# EasyEDA Pro project Athena.epro, board PCB (continued)
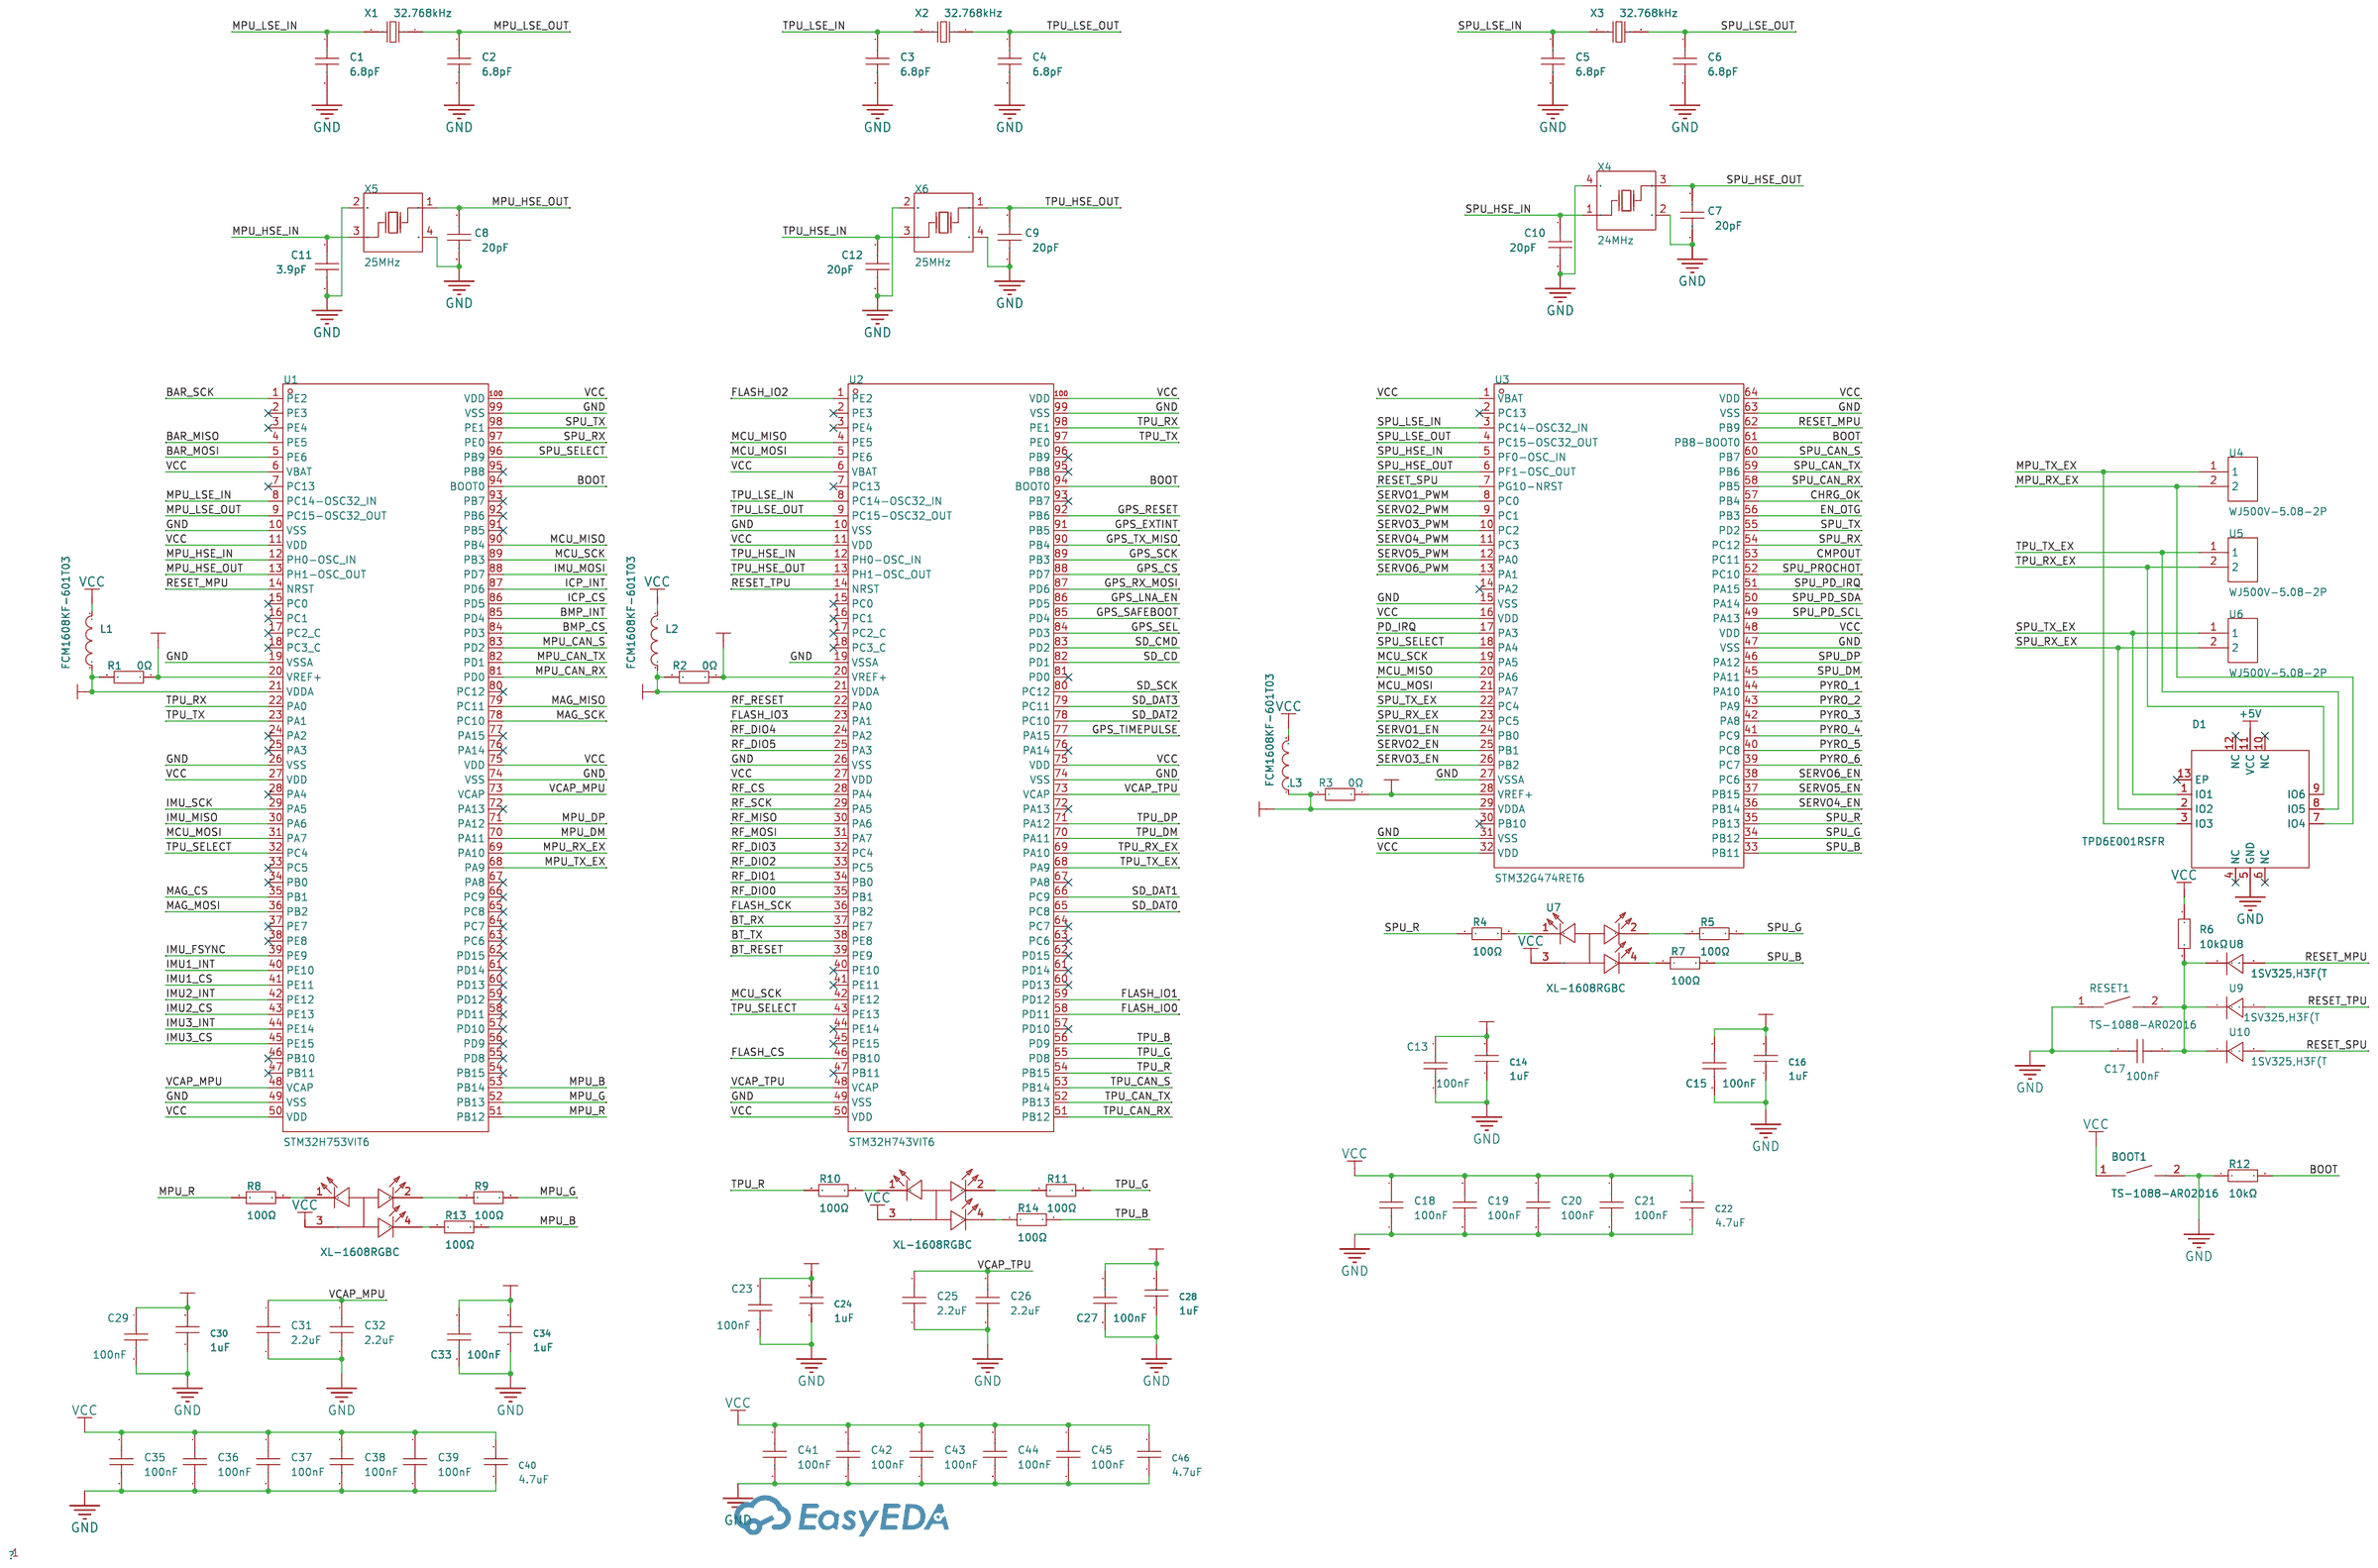
[diagram p0: Processors]
## Routing (per net, layer and track width the routed paths; a pad name or vN(x,y) marks a point on that pad's centre or on a via; arc(x,y) is an arc through that point) (continued)
RF_MOSI: length 46.1
  Top Layer w0.2: 18.86,90.71 17.8,91.77 17.8,124.4 23.9,130.5 26.95,130.5 U24.14
RF_RESET: length 46.2
  Top Layer w0.2: v1(12.8,128.65) 11.15,128.65 11.12,128.68 ; U2.22 23.09,90.65 22.35,90.65 21.58,91.42 21.58,121.07 v1(20.25,122.4)
  Bottom Layer w0.2: v1(20.25,122.4) 19.05,122.4 v1(12.8,128.65)
RF_SCK: length 42.3
  Top Layer w0.2: U24.12 21.48,126.68 18.8,124 18.8,92.19 19.57,91.42
SD_CD: length 33.2
  Top Layer w0.2: v1(23.78,76.58) 23.8,76.58 24.94,75.44
  SIGNAL w0.2: v1(16.87,101.9) 16.87,82.93 23.22,76.58 v1(23.78,76.58)
  Bottom Layer w0.2: R103.1 17.97,101.9 v1(16.87,101.9) 16.83,101.94 CARD1.CD
SD_CMD: length 39
  Top Layer w0.2: v1(23.4,77.2) 23.9,77.2 25.19,75.9 25.19,75.89 25.29,75.79
  SIGNAL w0.2: v1(16.33,108.54) 17.4,107.46 17.4,83.2 v1(23.4,77.2)
  Bottom Layer w0.2: R100.1 16.46,108.4 v1(16.33,108.54) CARD1.3
SD_DAT0: length 39.1
  Top Layer w0.2: v1(15.3,75) 15.3,75.06 17.09,76.85
  Bottom Layer w0.2: R101.1 16.91,104.14 CARD1.7 15.03,104.1 13,104.1 11.6,102.7 11.6,76.7 13.3,75 v1(15.3,75)
SD_DAT1: length 36.9
  Top Layer w0.2: v1(16.4,75.5) 16.49,75.59 16.49,75.6 17.39,76.5 17.45,76.5
  Bottom Layer w0.2: R102.1 15.11,103 CARD1.8 12.94,103.04 12.15,102.25 12.15,76.85 13.5,75.5 v1(16.4,75.5)
SD_DAT2: length 42.8
  Top Layer w0.2: 23.53,74.02 22.74,74.81 v1(22.61,74.81)
  SIGNAL w0.2: v1(22.61,74.81) 15.3,82.12 15.3,109.69 v1(16.32,110.71)
  Bottom Layer w0.2: R98.1 16.41,110.8 v1(16.32,110.71) 16.29,110.74 CARD1.1
SD_DAT3: length 41.1
  Top Layer w0.2: v1(23.1,75.1) 23.16,75.1 23.88,74.38
  SIGNAL w0.2: v1(16.32,109.64) 15.8,109.12 15.8,82.4 v1(23.1,75.1)
  Bottom Layer w0.2: R99.1 17.23,109.64 v1(16.32,109.64) CARD1.2
SD_SCK: length 36.1
  Top Layer w0.2: v1(23.4,75.6) 23.4,75.56 24.23,74.73
  SIGNAL w0.2: v1(16.32,106.34) 16.32,82.68 v1(23.4,75.6)
  Bottom Layer w0.2: CARD1.5 v1(16.32,106.34)
SERVO1_EN: length 108.4
  Top Layer w0.2: Q12.1 25.85,12.05 v1(25.9,12.1) ; v1(54.58,68.18) 62.6,76.2 62.6,77.5 61.52,78.58 U3.24
  SIGNAL w0.2: v1(54.58,68.18) 68.8,53.96 68.8,32.3 64.4,27.9 41.5,27.9 25.9,12.3 v1(25.9,12.1)
SERVO1_PWM: length 112.3
  Top Layer w0.2: v1(52,77.6) 53.37,78.97 U3.8
  SIGNAL w0.2: S1.3 25.3,12.29 41.31,28.3 64.2,28.3 68.4,32.5 68.4,53.7 50.1,72 50.1,75.7 v1(52,77.6)
SERVO2_EN: length 107.4
  Top Layer w0.2: U3.25 63,77.85 63,75.96 v1(55.55,68.51) ; Q13.1 29.2,11.15 v1(29.2,12.1)
  SIGNAL w0.2: v1(29.2,12.1) 29.2,14.4 41.9,27.1 64.8,27.1 69.6,31.9 69.6,54.46 v1(55.55,68.51)
SERVO2_PWM: length 111
  Top Layer w0.2: U3.9 53.72,78.62 v1(52.7,77.6)
  SIGNAL w0.2: v1(52.7,77.6) 50.9,75.8 50.9,72.5 69.2,54.2 69.2,32.1 64.6,27.5 41.7,27.5 28.15,13.95 S2.3
SERVO3_EN: length 106.4
  Top Layer w0.2: v1(56.52,68.82) 63.4,75.7 63.4,78.16 62.23,79.33 ; Q14.1 v1(32.45,12.1)
  SIGNAL w0.2: v1(56.52,68.82) 70.4,54.94 70.4,31.5 65.2,26.3 42.3,26.3 32.45,16.45 v1(32.45,12.1)
SERVO3_PWM: length 109.5
  Top Layer w0.2: v1(52.7,76.9) 54.07,78.27 U3.10
  SIGNAL w0.2: v1(52.7,76.9) 51.8,76 51.8,72.9 70,54.7 70,31.7 65,26.7 42.1,26.7 31.01,15.61 S3.3
SERVO4_EN: length 105.1
  Top Layer w0.2: Q15.1 v1(49.15,13.95) ; v1(57.49,69.15) 66.1,77.76 66.1,86 65.47,86.63 64.59,86.63 U3.36
  SIGNAL w0.2: v1(49.15,13.95) 49.15,22.95 51.7,25.5 65.57,25.5 71.2,31.13 71.2,55.44 v1(57.49,69.15)
SERVO4_PWM: length 96.7
  Top Layer w0.2: v1(53.4,76.9) 54.41,77.91 U3.11
  SIGNAL w0.2: S4.3 48.66,23.06 51.5,25.9 65.4,25.9 70.8,31.3 70.8,55.2 52.6,73.4 52.6,76.1 v1(53.4,76.9)
SERVO5_EN: length 103.1
  Top Layer w0.2: v1(58.46,69.48) 66.5,77.52 66.5,86.2 65.6,87.1 64.35,87.1 U3.37 ; Q16.1 v1(52.45,11.9)
  SIGNAL w0.2: v1(52.45,11.9) 52.45,22.05 55.1,24.7 66,24.7 72,30.7 72,55.94 v1(58.46,69.48)
SERVO5_PWM: length 93.6
  Top Layer w0.2: U3.12 54.76,77.56 v1(53.4,76.2)
  SIGNAL w0.2: v1(53.4,76.2) 53.4,73.9 71.6,55.7 71.6,30.9 65.8,25.1 54.9,25.1 51.52,21.72 S5.3
SERVO6_EN: length 102.2
  Top Layer w0.2: v1(59.43,69.81) 66.9,77.28 66.9,86.4 65.8,87.5 64.04,87.5 U3.38 ; Q17.1 v1(55.75,12)
  SIGNAL w0.2: v1(59.43,69.81) 72.8,56.44 72.8,30.3 66.4,23.9 56.6,23.9 55.75,23.05 v1(55.75,12)
SERVO6_PWM: length 91.6
  Top Layer w0.2: 55.16,77.2 55.16,77.16 v1(54.2,76.2)
  SIGNAL w0.2: v1(54.2,76.2) 54.2,74.4 72.4,56.2 72.4,30.5 66.2,24.3 56.4,24.3 54.87,22.77 54.87,7.24 54.47,6.84 S6.3
SPU_B: length 16.7
  Top Layer w0.2: v1(75.5,92.9) 75.5,92.9 R7.2 ; U3.33 64.4,84.28 65.32,85.2 v1(65.55,85.2)
  SIGNAL w0.2: v1(65.55,85.2) 65.59,85.24 67.84,85.24 v1(75.5,92.9)
SPU_CAN_RX: length 40.6
  Top Layer w0.2: 53.04,86.4 51.93,87.5 50.55,87.5 46.8,83.75 46.8,73.85 50.95,69.7 50.95,61.5 48.06,58.61 U25.4
SPU_CAN_S: length 43.2
  Top Layer w0.2: U25.8 52.42,49.32 52.42,69.53 47.7,74.25 47.7,83.45 50.9,86.65 51.37,86.65 U3.60
SPU_CAN_TX: length 38.5
  Top Layer w0.2: U25.1 51.87,69.43 47.25,74.05 47.25,83.6 50.75,87.1 51.68,87.1 52.68,86.09 U3.59
SPU_DM: length 115.4
  Top Layer w0.2: U23.11 52.68,19.4 52.91,19.62 53.25,19.62 53.6,19.97 53.6,22.25 54.26,22.9 54.26,24.82 51.29,27.78 51.29,27.98 R94.2 51.29,29.1 51.29,30.9 51.39,31 v1(51.39,31.4) ; v1(58.6,87) 60.11,88.51 U3.45
  SIGNAL w0.2: v1(51.39,31.4) 51.39,31.8 51.29,31.9 51.29,32.25 49.39,34.15 32.75,34.15 24.15,42.75 24.15,64.05 35.29,75.2 46.65,75.2 58.46,87 v1(58.6,87)
SPU_DP: length 115.3
  Top Layer w0.2: U3.46 59.75,88.85 v1(58.6,87.7) ; v1(50.84,31.4) 50.84,31 50.94,30.9 50.94,29.18 R93.2 50.94,28.06 50.94,27.63 53.9,24.67 53.9,23.05 53.25,22.39 53.25,20.12 53.11,19.98 52.91,19.98 52.68,20.2 U23.12
  SIGNAL w0.2: v1(58.6,87.7) 58.6,87.64 58.37,87.41 58.01,87.41 57.11,86.51 57.11,86.15 46.51,75.55 35.15,75.55 23.8,64.2 23.8,42.6 32.6,33.8 49.24,33.8 50.94,32.1 50.94,31.9 50.84,31.8 v1(50.84,31.4)
SPU_G: length 15.7
  Top Layer w0.2: v1(65.17,85.69) 65.06,85.69 U3.34 ; R5.2 74.25,94.87 v1(74.25,92.89)
  SIGNAL w0.2: v1(65.17,85.69) 67.05,85.69 v1(74.25,92.89)
SPU_HSE_IN: length 6.1
  Top Layer w0.2: U3.5 50.7,78.4 v1(50.7,77.36)
  Bottom Layer w0.2: X4.1 51.04,77.02 v1(50.7,77.36) 50.12,77.36 C10.1
SPU_HSE_OUT: length 9.7
  Top Layer w0.2: v1(51.19,77.71) 51.19,78.15 52.58,79.54 52.58,79.58 U3.6
  Bottom Layer w0.2: 52.74,72.1 52.43,72.1 X4.3 51.39,74.69 52.21,75.51 52.21,76.69 v1(51.19,77.71)
SPU_LSE_IN: length 6.9
  Top Layer w0.2: v1(48.35,79.31) 50.19,79.31 U3.3
  Bottom Layer w0.2: v1(48.35,79.31) 47.5,80.15 X3.2 46.23,78.97 C5.1
SPU_LSE_OUT: length 7.2
  Top Layer w0.2: v1(48.35,78.71) 50.3,78.71 U3.4
  Bottom Layer w0.2: 49.12,78.39 47.8,77.06 ; 49.12,78.39 48.67,78.39 v1(48.35,78.71) ; 49.12,78.39 X3.1
SPU_PD_IRQ: length 59.8
  Top Layer w0.2: U3.51 57.25,87.13 57.25,73.4 52.8,68.95 52.8,50.52 62.75,40.57 62.75,39.2 64.2,37.75 v1(64.2,37.2)
  Bottom Layer w0.2: U20.10 64.14,37.26 v1(64.2,37.2)
SPU_PD_SCL: length 59.9
  Top Layer w0.2: v1(63.6,39.66) 63.6,40.95 53.7,50.85 53.7,68.55 58.04,72.89 58.04,87.75 56.22,89.58
  Bottom Layer w0.2: v1(63.6,39.66) 63.88,39.66 64.45,39.09 64.45,38.1 64.01,37.66 U20.9
SPU_PD_SDA: length 58.9
  Top Layer w0.2: U3.50 57.65,87.44 57.65,73.15 53.25,68.75 53.25,50.67 63.15,40.77 63.15,39.47 63.51,39.11 v1(63.55,39.11)
  Bottom Layer w0.2: v1(63.55,39.11) 63.84,39.11 64.07,38.88 64.07,38.27 63.86,38.06 U20.8
SPU_PROCHOT: length 74.6
  Top Layer w0.2: U3.52 53.27,90.4 50.9,90.4 44.95,84.45 44.95,73.2 49.35,68.8 49.35,62.3 45.65,58.6 45.65,49.73 40.82,44.9 38.47,44.9 33.92,40.35 32.75,40.35 31.75,39.35 31.75,38.71 32.06,38.4 33,38.4 v1(33.05,38.45)
  Bottom Layer w0.2: v1(33.05,38.45) 33.32,38.45 33.56,38.21 33.86,38.5 U19.11
SPU_R: length 14.6
  Top Layer w0.2: R4.1 72.96,92.91 v1(72.95,92.9) ; v1(64.85,86.18) 63.65,84.98 U3.35
  SIGNAL w0.2: v1(64.85,86.18) 66.23,86.18 v1(72.95,92.9)
SPU_RX: length 10.4
  Top Layer w0.2: U1.97 49.45,94.45 v1(49.45,94.45) ; v1(53,89.25) 53.01,89.25 U3.54
  Bottom Layer w0.2: v1(49.45,94.45) 53,90.9 v1(53,89.25)
SPU_RX_EX: length 65.4
  Top Layer w0.2: v1(13.2,67.7) 13.22,67.72 v1(15.37,67.72) ; v1(60.05,79.4) 60.05,79.38 U3.23
  SIGNAL w0.2: v1(60.05,79.4) 57.82,81.62 53.78,81.62 46.43,74.28 38.07,74.28 31.7,67.9 v1(31.7,67.85)
  Bottom Layer w0.2: v1(31.7,67.85) 31.4,67.55 31.39,67.55 31.39,67.55 15.54,67.55 v1(15.37,67.72) ; U6.2 10.34,64.84 v1(13.2,67.7) 13.8,68.3 D1.2
SPU_SELECT: length 23.6
  Top Layer w0.2: v1(58.5,77.9) 58.5,77.4 U3.18 ; U1.96 48.69,94.5 v1(48.7,94.5)
  Bottom Layer w0.2: v1(48.7,94.5) 52.55,90.65 52.55,88.44 55.8,85.18 55.8,80.7 58.5,78 v1(58.5,77.9)
SPU_TX: length 11.1
  Top Layer w0.2: U3.55 53.04,88.52 v1(53.04,88.59) ; v1(49.55,95.05) 49.55,95.05 U1.98
  Bottom Layer w0.2: v1(53.04,88.59) 53.45,89 53.45,91.15 v1(49.55,95.05)
SPU_TX_EX: length 67.3
  Top Layer w0.2: v1(59.48,79.33) 59.48,79.25 60.81,77.91
  SIGNAL w0.2: v1(59.48,79.33) 59.48,79.43 57.66,81.25 53.95,81.25 46.6,73.9 38.25,73.9 32.27,67.92 v1(32.27,67.83)
  Bottom Layer w0.2: U6.1 6.31,59.76 14.6,68.05 ; v1(32.27,67.83) 32.27,67.78 31.69,67.2 15.25,67.2 14.6,67.85 14.6,68.05 ; 14.6,68.05 D1.1
TPU_B: length 24.9
  Top Layer w0.2: v1(15.4,81.13) 14.98,81.13 U2.56 ; v1(4.35,93.55) 4.35,95.44 R14.2
  GND w0.2: v1(15.4,81.13) 8.57,81.13 7.1,82.6 7.1,90.75 4.35,93.5 v1(4.35,93.55)
TPU_CAN_RX: length 44.2
  Top Layer w0.2: U26.4 28.25,56.35 24.25,60.35 11.65,60.35 8.9,63.1 8.9,78.58 12.12,81.8
TPU_CAN_S: length 54
  Top Layer w0.2: U2.53 9.9,78.17 9.9,63.55 12.1,61.35 28.35,61.35 33.7,56 33.7,49.75 32.73,48.78 U26.8
TPU_CAN_TX: length 47.3
  Top Layer w0.2: U26.1 32.06,56.84 28.05,60.85 11.85,60.85 9.4,63.3 9.4,78.38 U2.52
TPU_DM: length 70.9
  Top Layer w0.2: v1(17.62,73.87) 17.65,73.87 18.86,75.08 ; v1(33.2,32.65) 33.6,32.65 33.7,32.55 38.99,32.55 42.4,29.14 42.4,28.79 R87.2 42.4,27.8 42.4,27.6 43.2,26.8 48.03,26.8 48.38,26.45 48.38,26.11 48.6,25.88 U23.19
  SIGNAL w0.2: v1(17.62,73.87) 17.62,73.78 22.6,68.8 22.6,42.25 32.3,32.55 33.1,32.55 v1(33.2,32.65)
TPU_DP: length 70.8
  Top Layer w0.2: 19.21,74.73 17.63,73.14 v1(17.63,73.13) ; v1(33.2,32.1) 33.6,32.1 33.7,32.2 38.84,32.2 42.05,29 42.05,28.79 R86.2 42.05,27.8 42.05,27.45 43.05,26.45 47.88,26.45 48.02,26.31 48.02,26.11 47.8,25.88 U23.20
  SIGNAL w0.2: v1(17.63,73.13) 17.77,73.13 18.38,72.52 18.38,72.17 19.28,71.27 19.63,71.27 22.25,68.65 22.25,42.11 32.15,32.2 33.1,32.2 v1(33.2,32.1)
TPU_G: length 23.7
  Top Layer w0.2: v1(15.12,81.65) 14.79,81.65 U2.55 ; R11.2 v1(5.77,93.55)
  GND w0.2: v1(5.77,93.55) 5.92,93.55 7.5,91.97 7.5,82.75 8.65,81.6 15.07,81.6 v1(15.12,81.65)
TPU_HSE_IN: length 5.7
  Top Layer w0.2: 27.39,87.89 27.39,87.89 v1(28.4,88.9)
  Bottom Layer w0.2: X6.3 29.67,90.17 v1(28.4,88.9)
  Bottom Layer w0.4: 31.01,90 30.1,90.91 X6.3
TPU_HSE_OUT: length 8.8
  Top Layer w0.2: U2.13 v1(27.8,89)
  Bottom Layer w0.2: v1(27.8,89) 28.4,89.6 28.4,91.2 29.42,92.22 29.42,93.57
  Bottom Layer w0.4: 27.08,94.06 27.13,94.01 27.9,94.01 27.96,94.06 28.92,94.06 X6.1
TPU_LSE_IN: length 7.7
  Top Layer w0.2: v1(29.85,87.5) 29.84,87.5 U2.8
  Bottom Layer w0.2: 33.86,86.79 31.94,86.79 31.22,87.5 v1(29.85,87.5)
  Bottom Layer w0.4: C3.1 35.24,88.16 X2.2
TPU_LSE_OUT: length 6.3
  Top Layer w0.2: U2.9 29.18,87.55 v1(29.2,87.55)
  Bottom Layer w0.2: X2.1 30.26,88.61 v1(29.2,87.55)
  Bottom Layer w0.4: X2.1 32.15,88.62 C4.1
TPU_R: length 23.4
  Top Layer w0.2: v1(7.15,93.55) 7.17,93.57 R10.1 ; v1(14.85,82.9) 14.85,82.41 U2.54
  GND w0.2: v1(14.85,82.9) 14.85,82.85 14.1,82.1 8.75,82.1 7.85,83 7.85,92.9 7.2,93.55 v1(7.15,93.55)
TPU_RX: length 32.2
  Top Layer w0.2: U1.22 41.03,105.45 v1(41.03,105.44) ; U2.98 31.16,80.52 32.48,80.52 v1(32.5,80.54)
  SIGNAL w0.2: v1(41.03,105.44) 40.98,105.39 40.69,105.39 32.3,97 32.3,80.74 v1(32.5,80.54)
TPU_RX_EX: length 22.9
  Top Layer w0.2: U2.69 17.08,74.04 v1(17.01,74.04)
  Bottom Layer w0.2: 14.6,73.08 7.95,79.73 7.95,84.89 U5.2 ; 14.6,73.08 14.73,72.95 15.1,72.95 16.19,74.04 v1(17.01,74.04) ; 14.6,73.08 D1.9
TPU_SELECT: length 37.7
  Top Layer w0.2: U1.32 37.35,104.42 37.35,99 34.7,96.35 v1(34.25,96.35) ; v1(13,88.05) 14.58,86.47 U2.43
  Bottom Layer w0.2: v1(13,88.05) 21.25,96.3 34.2,96.3 v1(34.25,96.35)
TPU_TX: length 32.7
  Top Layer w0.2: U1.23 40.76,105.89 v1(40.68,105.89) ; v1(32.02,80.06) 30.9,80.06 U2.97
  SIGNAL w0.2: v1(40.68,105.89) 40.68,105.81 32,97.12 32,80.09 v1(32.02,80.06)
TPU_TX_EX: length 19.1
  Top Layer w0.2: v1(16.5,73.59) 16.5,74.16 U2.68
  Bottom Layer w0.2: U5.1 5.8,81.08 13.8,73.08 D1.8 13.8,72.5 14.15,72.15 15.06,72.15 v1(16.5,73.59)
USB_CC1: length 12.4
  Top Layer w0.2: v1(37.6,12.9) 37.6,8.78 38.75,7.63 USB1.4
  Bottom Layer w0.2: D2.7 39.78,12.72 39.78,13.22 39.62,13.38 37.95,13.38 37.6,13.03 v1(37.6,12.9) 37.52,12.82 37.52,12.75 37.59,12.69 37.52,12.62 37.52,12.04 37.96,11.6 D2.4
USB_CC2: length 8.7
  Top Layer w0.2: USB1.10 41.75,9.65 v1(38.8,12.6)
  Bottom Layer w0.2: D2.5 38.7,12.5 v1(38.8,12.6) 39.3,12.6 D2.6
USB_DN: length 14.4
  Top Layer w0.2: R96.1 45.52,12.94 45.52,11.52 v1(42.9,8.9) ; 39.3,7 39.25,6.95 USB1.5 ; 39.3,7 v1(39.3,7.91) ; 39.3,7 39.32,7.02 39.32,7.04 39.48,7.2 40.02,7.2 40.25,6.97 USB1.7
  Bottom Layer w0.2: D2.20 39.4,8.01 v1(39.3,7.91) 41.91,7.91 v1(42.9,8.9)
USB_DP: length 13.3
  Top Layer w0.2: v1(39.98,8.5) 40.75,7.74 USB1.8 40.75,5.75 40.55,5.55 39.98,5.55 39.75,5.78 USB1.6 ; R95.1 44.35,11.48 v1(42.49,9.61)
  Bottom Layer w0.2: v1(42.49,9.61) 41.38,8.5 v1(39.98,8.5) 39.8,8.69 D2.19
USB_SBU1: length 5.7
  Top Layer w0.2: v1(38.7,9.6) 39.21,9.09 40.23,9.09 41.25,8.06 USB1.9
  Bottom Layer w0.2: v1(38.7,9.6) D2.1
USB_SBU2: length 5.7
  Top Layer w0.2: USB1.3 38.25,6.38 38.25,7.15 37.5,7.9 v1(37.4,7.9)
  Bottom Layer w0.2: v1(37.4,7.9) 37.44,7.94 37.44,9.63 37.73,9.92 37.73,10.41 38.14,10.82 38.68,10.82 D2.2
USB_XTAL1: length 9.5
  Top Layer w0.2: U23.30 v1(38.9,19.4)
  Bottom Layer w0.2: v1(38.9,19.4) 37.69,18.19 X7.1 38.56,15.97 C114.1
USB_XTAL2: length 9.8
  Top Layer w0.2: v1(38.9,20.2) U23.29
  Bottom Layer w0.2: C116.1 40.23,24.04 X7.3 38.9,21.8 v1(38.9,20.2)
VCAP_MPU: length 16.2
  Top Layer w0.2: v1(38.8,89.78) 37.94,88.92 U1.73 ; v1(31.55,98.93) 30.89,99.6 U1.48
  GND w0.2: v1(38.8,89.78) 31.55,97.03 v1(31.55,98.93)
  Bottom Layer w0.2: C31.1 38.8,89.91 v1(38.8,89.78) ; v1(31.55,98.93) 31.58,98.93 C32.1
VCAP_TPU: length 16.9
  Top Layer w0.2: v1(13.62,83.9) 12.85,84.67 12.85,84.7 ; 19.92,74.02 20.7,74.8 v1(20.72,74.8)
  GND w0.2: v1(13.62,83.9) 13.87,83.65 14.74,83.65 20.72,77.66 v1(20.72,74.8)
  Bottom Layer w0.2: v1(13.62,83.9) 13.92,83.6 C25.1 ; 20.56,75.92 20.72,75.76 v1(20.72,74.8)
VREF+_MPU: length 10.6
  Top Layer w0.2: 42.6,105.61 41.7,104.71 v1(41.7,99.3)
  Bottom Layer w0.2: R1.2 41.85,100.58 C33.1 40.62,99.31 C34.2 40.67,99.3 v1(41.7,99.3)
VREF+_SPU: length 6
  Top Layer w0.2: v1(61.2,80.9) 62.07,80.9 U3.28
  Bottom Layer w0.2: 59.75,80.91 R3.2 60.31,80.9 v1(61.2,80.9) ; 59.75,80.91 C16.2 ; 59.75,80.91 59.14,80.91 C15.1
VREF+_TPU: length 6.5
  Top Layer w0.2: v1(23,88.49) 23,89.15 U2.20
  Bottom Layer w0.2: 23.63,89.12 v1(23,88.49) ; 23.63,89.12 23.63,87.86 24.91,87.86 ; 23.63,89.12 23.68,89.17 R2.2
VSYS: length 13.7
  Top Layer w0.2: v1(19.2,29.6) 19.2,31.25 U14.2
  Bottom Layer w0.2: R15.2 v1(19.2,29.6) ; 31.2,42.87 30.17,42.87 29.64,43.4 v1(25.9,43.4)
  Bottom Layer w0.4: U17.5 13.64,61.26 14.59,60.31 U17.3 15.25,60.26 C59.1
  vias: v1(9.2,58.05) v1(9.2,57.05) v1(9.8,49.4) v1(10.2,58.05) v1(10.2,57.05) v1(10.55,49.4) v1(11.2,58.05) v1(11.2,57.05) v1(11.3,49.4) v1(11.8,32.1) v1(11.8,31.4) v1(11.8,30.7) v1(12.05,49.4) v1(12.2,58.05) v1(12.2,57.05) v1(12.55,32.1) v1(12.55,31.4) v1(12.55,30.7) v1(12.8,49.4) v1(13.2,58.05) v1(13.2,57.05) v1(13.3,32.1) v1(13.3,31.4) v1(13.3,30.7) v1(13.55,49.4) v1(14.05,32.1) v1(14.05,31.4) v1(14.05,30.7) v1(14.2,57.05) v1(14.3,49.4) v1(15.05,49.4) v1(15.8,49.4) v1(16.55,49.4) v1(17.3,49.4) v1(18.05,49.4) v1(18.8,49.4) v1(19.55,49.4) v1(20.3,49.4) v1(21.05,49.4)
$1N13958: length 1.6
  Top Layer w0.2: U11.1 41.83,117.07 R8.2
$1N14012: length 1.5
  Top Layer w0.2: R9.1 40.56,117.14 U11.2
$1N14042: length 2.3
  Top Layer w0.2: R13.1 39.29,118.2 39.65,118.56 U11.4
$1N15981: length 1.4
  Top Layer w0.2: R10.2 7.17,96.58 U12.1
$1N15984: length 1.3
  Top Layer w0.2: R11.1 5.77,96.78 U12.2
$1N15987: length 2.3
  Top Layer w0.2: R14.1 4.37,97.66 4.78,98.07 U12.4
$1N16115: length 3.6
  Top Layer w0.2: U7.1 72.55,97.55 72.2,97.2 72.2,96.08 72.53,95.75 R4.2
$1N16118: length 2.4
  Top Layer w0.2: R5.1 74.21,95.77 74.21,97.41 74.35,97.55 U7.2
$1N16121: length 1.4
  Top Layer w0.2: U7.4 75.5,96.2 R7.1
$1N31524: length 9.6
  Bottom Layer w0.4: U8.1 60.2,66.9 R6.1 60.2,63.02 RESET1.2 58.69,61.51 C17.1 ; U8.1 U9.1 ; U8.1 U10.1
$2N3293: length 1.2
  Bottom Layer w0.2: D2.9 40.62,12.72 40.62,13.22 40.67,13.26 R31.2
$2N3500: length 1.9
  Bottom Layer w0.2: C62.1 38.68,11.18 D2.3
$2N3865: length 1.3
  Bottom Layer w0.2: 62.29,23.42 61.71,23.42 R28.1
$2N3867: length 1
  Bottom Layer w0.2: R29.1 58.22,22.94 Q6.3
$2N3869: length 1.1
  Bottom Layer w0.2: Q3.2 61.47,19.51 R25.2
$2N3871: length 0.7
  Bottom Layer w0.2: Q4.2 59.07,19.91 R26.2
$2N4534: length 3.8
  Bottom Layer w0.2: U20.1 60.9,39.34 C86.1 60.91,40.74 U20.2
$2N4632: length 2.6
  Bottom Layer w0.2: U20.3 61.71,39.36 ; 61.71,39.36 U20.4 ; 61.71,39.36 61.71,40.27 C88.1
$2N6524: length 1.4
  Bottom Layer w0.2: C96.1 29.32,36.54 R48.1
$2N6614: length 1.4
  Bottom Layer w0.2: R49.1 27.91,36.54 C97.1
$2N6618: length 5.4
  Bottom Layer w0.2: U19.16 31.86,39.6 31.71,39.46 30,39.46 R48.2 29.43,38.77 C92.1
$2N6648: length 6.2
  Bottom Layer w0.2: 31.2,40.87 31.15,40.92 29.95,40.92 29.01,39.98 29.01,39.85 R49.2 27.74,38.75 C93.1
$2N6713: length 2.5
  Bottom Layer w0.2: U19.10 34.26,38.5 34.4,38.36 34.81,38.36 R52.1
$2N6978: length 2.9
  Bottom Layer w0.2: U19.9 34.66,39.54 36.08,38.12 C95.1
$2N7041: length 5.5
  Bottom Layer w0.2: 35.31,40.87 35.83,40.87 37.64,39.06 37.64,38.28 37.7,38.22 C94.1 38.53,38.12 38.6,38.18 38.64,38.18 R51.1
$2N7165: length 5.5
  Top Layer w0.2: 39.45,38.72 39.39,38.72 39.25,38.86 39.25,39.1 38.74,39.61 38.74,39.66 38.41,39.99 38.21,39.99 v1(36.6,41.6)
  Bottom Layer w0.2: U19.6 36.53,41.67 v1(36.6,41.6)
$2N7490: length 1.9
  Bottom Layer w0.4: C80.1 70.23,50.82 R34.2
$2N8943: length 25.5
  Top Layer w0.2: v1(42.81,43.73) 54.8,43.73 v1(56.88,45.8)
  Bottom Layer w0.2: 42.77,43.73 v1(42.81,43.73) ; 42.77,43.73 35.36,43.73 U19.1 ; 42.77,43.73 C83.2 ; R35.1 v1(56.88,45.8)
$2N9020: length 23.1
  Bottom Layer w0.2: R36.1 54.85,47.46 C81.2 54.77,47.44 50.21,42.87 35.31,42.87
$2N9137: length 15.5
  Bottom Layer w0.2: R37.1 48.24,45.34 C82.2 46.19,43.27 35.31,43.27
$2N10434: length 14.6
  Top Layer w0.4: v1(34.46,45.4) 40.42,45.4 43.6,48.58 v1(43.6,50.6)
  Bottom Layer w0.2: v1(34.46,45.4) 34.45,45.4 34.26,45.21 U19.31
  Bottom Layer w0.4: v1(43.6,50.6) 42.6,50.6 Q7.4
$2N10662: length 17.7
  SIGNAL w0.4: v1(44.4,52.5) 43.4,51.5 v1(36.9,51.5)
  Bottom Layer w0.2: v1(36.9,51.5) 36.9,50.9 33.46,47.46 U19.29
  Bottom Layer w0.4: v1(44.4,52.5) 43.28,52.5 43.26,52.49
$2N10738: length 8.9
  Bottom Layer w0.2: C77.1 33.86,47.25 U19.30
$2N10858: length 1.9
  Bottom Layer w0.2: U19.25 30.5,45.69 C78.1
$2N10954: length 19.4
  GND w0.4: v1(21.7,54.5) 25.55,54.5 29.35,50.7 29.35,45.65 29.75,45.25 31.66,45.25 v1(31.71,45.2)
  Bottom Layer w0.2: v1(31.71,45.2) 32,45.2 32.26,44.94 U19.26 ; Q11.4 22.87,54.5 v1(21.7,54.5)
$2N11170: length 13.9
  SIGNAL w0.2: v1(30.4,44.17) 27.33,44.17 25.2,46.3 25.2,50 v1(26.8,51.6)
  Bottom Layer w0.2: Q8.4 26.72,51.53 v1(26.8,51.6) ; U19.24 30.7,44.17 v1(30.4,44.17)
$2N11970: length 10.9
  Top Layer w0.2: v1(29.7,42.7) 22.58,42.7 v1(21.7,41.82)
  Bottom Layer w0.2: v1(29.7,42.7) 29.93,42.47 U19.21 ; Q9.4 v1(21.7,41.82)
$2N11975: length 12.5
  Bottom Layer w0.2: U19.20 29.45,42.07 28.88,42.65 26.43,42.65 25.3,41.53 25.3,39.8 25,39.5 R42.1
$2N11980: length 13.5
  Bottom Layer w0.2: R43.1 25,38.2 25.7,38.9 25.7,41.5 26.55,42.35 28.75,42.35 29.43,41.67 U19.19
$2N13081: length 6
  Bottom Layer w0.2: C58.2 13.99,62.11 14.84,61.26 U17.2
  Bottom Layer w0.4: L5.1 18.05,61.26 U17.2
$2N13097: length 1.5
  Bottom Layer w0.2: C58.1 12.9,63.69 U17.6
$2N13288: length 4.1
  Bottom Layer w0.2: U17.4 10.37,60.31 R30.2 10.27,60.34 R27.1
$2N22650: length 4.6
  Bottom Layer w0.2: 28.6,40.8 28.03,41.37 R50.1 ; 28.6,40.8 28.6,40.77 R53.2 ; 28.6,40.8 28.8,40.8 29.27,41.27 31.2,41.27
$2N34168: length 6.5
  Top Layer w0.2: R16.2 19.25,27.65 19.75,27.15 21.36,27.15 v1(21.69,27.47)
  Bottom Layer w0.2: U13.1 22.32,26.84 v1(21.69,27.47) 20.71,28.45
$2N34212: length 2.7
  Bottom Layer w0.2: R20.2 24.75,22.05 24.24,22.56 23.32,22.56
$2N34217: length 4.5
  Bottom Layer w0.2: R21.2 22.85,19.2 22.3,19.75 22.3,19.95 22.32,19.97 U13.10
$2N34232: length 3.4
  Bottom Layer w0.2: C48.2 26.27,26.18 25.15,25.06 23.5,25.06
$2N34237: length 1.6
  Bottom Layer w0.2: R17.2 24.09,25.56 23.32,25.56
$2N34482: length 2.6
  Bottom Layer w0.2: U13.17 17.39,24.56 C49.2
$2N34623: length 14.8
  Top Layer w0.2: Q1.4 v1(23.9,35.9)
  SIGNAL w0.2: v1(18.67,25.06) 18.67,30.67 v1(23.9,35.9)
  Bottom Layer w0.2: U13.18 v1(18.67,25.06)
$2N34654: length 5.3
  Top Layer w0.2: v1(20.8,27.6) 20.75,27.65 U14.1
  Bottom Layer w0.2: v1(20.8,27.6) 20.8,26.7 20.82,26.68 U13.20
$2N34904: length 4
  Bottom Layer w0.2: C54.2 19.91,20.66 U13.11 20.82,20.06 R22.1
$2N35129: length 25
  Top Layer w0.4: L4.1 23.21,26.71 17.59,26.71 v2(17.3,27)
  Bottom Layer w0.2: R22.2 16.56,19.14 15.68,20.02 15.68,24.29 17.27,25.88 C49.1 17.79,25.56 U13.19
  Bottom Layer w0.4: v2(17.3,27) 17.27,26.97 C49.1
$2N35132: length 25.4
  Top Layer w0.2: v1(18.4,22.5) 18.7,22.2 26.4,22.2 30.55,26.35 30.55,35.2 30.81,35.46 Q2.4
  Bottom Layer w0.2: 19.82,22.56 18.46,22.56 v1(18.4,22.5)
$2N35591: length 2
  Bottom Layer w0.2: R24.1 28.9,23.19 C56.2
$2N35748: length 2.3
  Bottom Layer w0.2: R19.1 31.51,28.89 C53.1
$3N1990: length 3.3
  Top Layer w0.2: U23.18 49.4,23.6 v1(50.1,22.9)
  Bottom Layer w0.2: R88.1 50.03,22.83 v1(50.1,22.9)
$3N1994: length 2.6
  Top Layer w0.2: v1(50.2,21.8) U23.14
  Bottom Layer w0.2: R90.1 49.9,21.5 v1(50.2,21.8)
$3N1999: length 3.5
  Top Layer w0.2: v1(50.2,18.6) U23.10
  Bottom Layer w0.2: v1(50.2,18.6) 50.2,19.13 R92.1
$3N2944: length 7
  Top Layer w0.2: R95.2 44.6,14.16 U23.1 44.7,16.46 v1(44.7,18.9)
  Bottom Layer w0.2: R97.2 44.88,20.17 44.7,19.99 v1(44.7,18.9)
$3N2998: length 2.5
  Top Layer w0.2: U23.2 45.4,14.13 R96.2
$3N4455: length 3.9
  Top Layer w0.2: R62.1 47.16,65.38 v1(45.51,65.38) FLASH1.7
  Bottom Layer w0.2: v1(45.51,65.38) 46.29,65.38 R58.1
$3N4459: length 4
  Top Layer w0.2: FLASH1.6 v1(45.49,64.11) R63.1
  Bottom Layer w0.2: v1(45.49,64.11) R65.2
$3N4464: length 4
  Top Layer w0.2: FLASH1.5 v1(45.5,62.84) 47.14,62.84 R64.1
  Bottom Layer w0.2: R57.1 46.23,62.84 v1(45.5,62.84)
$3N4469: length 3.9
  Top Layer w0.2: FLASH1.1 v1(34.5,66.65) R59.2
  Bottom Layer w0.2: v1(34.5,66.65) 33.75,66.65
$3N4474: length 3.9
  Top Layer w0.2: FLASH1.2 v1(34.52,65.38) R60.2
  Bottom Layer w0.2: 33.76,65.42 33.8,65.38 v1(34.52,65.38)
$3N4479: length 3.9
  Top Layer w0.2: R61.2 v1(34.51,64.11) FLASH1.3
  Bottom Layer w0.2: v1(34.51,64.11) 34.48,64.15 33.76,64.15
$3N4818: length 4.1
  Top Layer w0.2: v1(47,18) U23.4
  Bottom Layer w0.2: 46.56,18.91 46.56,18.44 v1(47,18) 47.06,18 C117.1
$3N9159: length 2.4
  Top Layer w0.157: R84.2 58.05,124.45 58.3,124.2
$3N9241: length 26.4
  Top Layer w0.157: 58.3,122 55.09,122 L7.2 50,121.95 40,131.95 RF1.5
$3N9247: length 3.9
  Top Layer w0.157: R84.1 53.47,124.45 C111.1 54.81,123.05 L7.1
$3N11683: length 2.9
  Top Layer w0.2: PYRO1.1 68.06,14.2 v1(68.8,14.2)
  Bottom Layer w0.2: 70.74,13.7 70.24,14.2 v1(68.8,14.2)
$3N11891: length 2.9
  Bottom Layer w0.4: 71.6,15.2 R78.1 71.6,12.33 R66.2
$3N11949: length 7.1
  Top Layer w0.2: v1(68.8,15.3) 68.04,15.3 PYRO1.2
  Bottom Layer w0.2: 72.55,17.2 71.55,16.2 69.7,16.2 v1(68.8,15.3)
  Bottom Layer w0.4: P1.1 74.22,17.2 72.55,17.2
$3N11962: length 3.1
  Bottom Layer w0.4: F1.1 75.56,13.46 P1.2
$3N11980: length 1.8
  Bottom Layer w0.4: R72.2 70.61,17.24 70.65,17.2
$3N11988: length 19.3
  Bottom Layer w0.4: 70.6,23.5 70.6,22.53 ; 70.6,22.53 71.33,21.8 v3(72.3,21.8) ; 70.6,22.53 70.6,22.5 ; 70.58,34.68 70.6,34.67 ; 70.58,34.68 70.6,34.7 ; 70.58,34.68 R68.1 ; 70.58,34.68 70.58,33.65 71.73,32.5 v3(73.5,32.5) ; R66.1 70.77,11.33 71.5,10.6 v3(72.47,10.6) ; v3(72.3,79.9) 71.33,79.9 70.6,80.63 ; 70.7,59.38 R69.1 ; 70.6,80.7 R71.1 ; 70.7,59.4 70.7,58.43 71.43,57.7 v3(72.4,57.7) ; 70.6,70.5 70.6,69.53 71.33,68.8 v3(72.3,68.8)
$3N12222: length 2.5
  Top Layer w0.2: v1(68.9,25.3) 68.38,25.3 PYRO2.1
  Bottom Layer w0.2: v1(68.9,25.3) 70.19,25.3 R79.2
$3N12224: length 2.9
  Bottom Layer w0.4: 71.43,26.39 71.43,23.53 R67.2
$3N12227: length 6.8
  Top Layer w0.2: 68.33,26.33 68.36,26.3 v1(69.5,26.3)
  Bottom Layer w0.2: v1(69.5,26.3) 70.6,27.4 71.39,27.4 72.38,28.39
  Bottom Layer w0.4: 72.38,28.39 74.19,28.39 P2.1
$3N12231: length 3.1
  Bottom Layer w0.4: F2.1 75.57,24.67 P2.2
$3N12235: length 1.6
  Bottom Layer w0.4: R73.2 70.56,28.48 70.48,28.39
$3N12474: length 3.8
  Top Layer w0.2: v1(67.7,36.4) 68.39,36.4 PYRO3.1
  Bottom Layer w0.2: v1(67.7,36.4) 70.17,36.4 R80.2
$3N12476: length 2.9
  Bottom Layer w0.4: 71.52,37.61 71.52,34.78 R68.2
